# EAGLE board BMS-HVver2.5 (EAGLE 7.7.0), part 2 of 2
## Tracks (layer width: path | path; a pad name or v marks a point on that pad's centre or on a via) (continued)
N$17 (continued)
  Top 0.406: Q8.1 123.93,74.63 arc-45 124.11,74.56 124.92,73.75 126.03,73.75 arc45 R18.1
N$18
  Top 0.406: R56.P$2 108.48,73.81 arc45 108.66,73.88 R57.P$2 114.7,76.98 arc45 114.88,77.05 115.67,77.84 117.21,77.84 arc45 D5.A 118.89,77.9 arc-45 119.06,77.83 119.41,77.49 119.41,76.17 arc45 119.48,75.99 119.94,75.53 120.57,75.53 arc45 Q8.3
N$19
  Top 0.406: R19.2 116.98,75.54 arc45 117.16,75.62 D5.C
N$20
  Top 0.406: Q6.1 123.6,59.14 arc-45 123.78,59.06 124.21,58.64 124.21,57.86 arc45 124.28,57.68 124.56,57.4 125.94,57.4 arc-45 126.12,57.32 R21.1
N$21
  Top 0.406: R52.P$2 108.48,61.1 arc45 108.66,61.18 R53.P$2 116.01,64.28 arc-45 116.19,64.21 D6.A 117.13,63.26 118.16,63.26 118.34,63.09 118.34,60.6 118.85,60.09 Q6.3
N$22
  Top 0.406: R22.2 115.47,62.72 arc-45 115.65,62.64 D6.C
N$23
  Top 0.406: R56.P$1 114.84,73.81 arc45 R19.1 119.39,73.84 arc-45 119.57,73.77 120.12,73.22 120.12,69.95 arc45 120.19,69.77 120.47,69.49 122.5,69.49 arc-45 122.68,69.41 122.96,69.13 122.96,68.5 arc-45 Q7.2 125.72,68.41 arc45 125.9,68.48 R17.1
  Bottom 0.406: R57.P$1 108.42,76.98 arc-45 108.6,76.91 R56.P$1 arc45 111.76,73.95 111.76,75.18 111.93,75.34 arc-45 112.11,75.42 F30.2
N$24
  Top 0.406: Q7.1 125.72,66.5 arc-45 125.9,66.43 R24.1
N$25
  Top 0.406: R54.P$2 108.48,67.45 arc45 108.66,67.53 R55.P$2 113.89,70.63 arc-45 114.07,70.56 115.49,69.13 116.63,69.13 arc-45 116.81,69.06 117.09,68.78 D7.A 120.17,68 arc-45 120.35,67.92 Q7.3
N$26
  Top 0.406: R25.2 115.53,67.92 arc-45 115.71,67.85 116.03,67.53 116.03,66.04 arc45 116.1,65.86 116.21,65.75 116.84,65.75 arc45 117.03,65.83 D7.C
N$27  (via drill 0.5)
  Top 0.406: R54.P$1 111.7,66.81 arc45 111.77,66.63 112.29,66.11 114.72,66.11 arc45 114.89,66.18 R25.1 114.94,65.35 arc45 115.01,65.17 115.32,64.86 121.79,64.86 arc-45 121.97,64.79 122.78,63.98 122.78,61.26 | 122.78,61.26 arc-45 122.71,61.08 Q6.2 | R23.1 125.74,60.24 v124.56,60.24 123.54,61.26 122.78,61.26
  Bottom 0.406: R55.P$1 108.42,70.63 arc-45 108.6,70.56 R54.P$1 | F31.2 124.71,60.39 v124.56,60.24
N$28
  Top 0.406: R52.P$1 114.74,61.1 arc-45 114.92,61.03 R22.1 114.94,60.02 arc45 115.01,59.84 115.67,59.17 119.66,59.17 arc-45 119.84,59.1 120.47,58.46 120.47,58.21 arc45 120.55,58.03 121.01,57.57 122.32,57.57 arc-45 122.5,57.5 122.96,57.04 122.96,54.79 arc-45 Q5.2 125.72,54.69 arc45 125.9,54.76 R20.1
  Bottom 0.406: R53.P$1 108.42,64.28 arc-45 108.6,64.21 R52.P$1 arc-45 111.76,61.13 117.45,61.13 117.91,60.67 arc-45 117.98,60.49 117.98,50.28 117.61,49.91 arc-45 117.43,49.84 F32.2
N$29
  Top 0.406: Q5.1 125.99,52.79 arc-45 R27.1
N$30
  Top 0.406: R50.P$2 108.48,54.76 arc45 108.66,54.83 R51.P$2 112.19,57.93 arc45 112.37,58 112.83,58.46 118.41,58.46 arc-45 118.59,58.39 118.87,58.11 118.87,57.09 arc45 D9.A 120.21,57.02 arc-45 120.39,56.95 120.83,56.51 120.83,53.76 arc-45 Q5.3
N$31
  Top 0.406: R28.2 117.18,57.38 arc-45 117.36,57.31 117.81,56.86 117.81,56.26 arc45 117.88,56.08 118.16,55.8 118.59,55.8 arc-45 118.77,55.72 118.87,55.62 118.87,54.99 arc45 D9.C
N$32  (via drill 0.5)
  Top 0.406: R50.P$1 111.7,55.28 arc-45 111.77,55.45 112.29,55.97 114.79,55.97 arc-45 114.97,55.9 R28.1 116.92,55.68 arc-45 117.1,55.61 117.45,55.26 117.45,54.46 118.25,53.66 118.25,53.22 118.87,52.6 120.55,52.6 arc-45 120.72,52.52 121.18,52.06 121.18,50.39 arc45 121.26,50.21 121.54,49.93 122.89,49.93 arc-45 Q4.2 125.72,49.86 arc45 125.9,49.94 R26.1 | v123.85,45.31 121.72,45.31 v121.36,45.66
  Bottom 0.406: R51.P$1 108.42,57.93 arc-45 108.6,57.86 R50.P$1 arc45 111.76,54.73 113.18,54.73 113.64,54.27 arc-45 113.72,54.09 113.72,49.22 114.18,48.76 arc45 114.35,48.68 119.05,48.68 119.51,48.23 arc-45 119.58,48.05 119.58,46.2 120.12,45.66 v121.36,45.66 | F33.2 124.84,41.12 124.21,41.75 124.21,44.95 v123.85,45.31
N$33
  Top 0.406: Q4.1 125.86,47.96 arc45 126.04,48.04 R30.1
N$34
  Top 0.406: R48.P$2 108.48,48.41 arc45 108.66,48.48 R49.P$2 117.91,51.58 arc-45 118.09,51.51 D10.A 119.52,51.49 arc-45 119.7,51.41 120.12,51 120.12,49.85 arc45 120.19,49.67 Q4.3
N$35
  Top 0.406: R31.2 117.76,49.64 arc-45 117.94,49.56 D10.C
N$36
  Top 0.406: R48.P$1 113.36,48.41 arc-45 113.54,48.33 114.07,47.8 114.94,47.8 arc45 115.12,47.87 R31.1 arc45 115.14,47.81 115.14,47.26 115.42,46.98 arc45 115.6,46.91 116.38,46.91 116.74,46.55 119.23,46.55 120.29,45.48 120.29,43.71 120.83,43.17 122.71,43.17 Q2.2 124.37,43.26 arc-45 124.55,43.19 124.92,42.82 124.92,42.39 arc45 124.99,42.21 125.27,41.93 125.92,41.93 arc45 126.1,42 R29.1
  Bottom 0.406: R49.P$1 108.42,51.58 arc-45 108.6,51.51 R48.P$1 | F34.2 116.8,32.31 arc45 116.98,32.39 117.81,33.22 117.81,47.16 arc45 117.73,47.34 117.17,47.9 112.21,47.9 R48.P$1 | 111.88,48.23 R48.P$1
N$37
  Top 0.406: Q2.1 123.78,41.36 arc-45 123.96,41.28 124.92,40.33 125.98,40.33 arc-45 R33.1
N$38
  Top 0.406: R46.P$2 108.48,42.05 arc45 108.66,42.13 R47.P$2 117.46,45.23 arc45 117.64,45.3 D11.A 119.09,45.52 arc-45 119.27,45.44 119.58,45.13 119.58,42.92 arc45 119.66,42.74 119.94,42.46 120.44,42.46 arc-45 120.62,42.39 Q2.3
N$39
  Top 0.406: R34.2 117.5,43.67 arc-45 117.68,43.59 D11.C
N$40
  Top 0.406: R46.P$1 114.74,42.05 arc-45 114.92,41.98 R34.1 118.91,41.97 arc-45 119.09,41.89 119.58,41.39 119.58,40.79 arc45 119.66,40.61 119.94,40.33 122.32,40.33 arc-45 122.5,40.25 122.78,39.97 122.78,38.93 arc45 122.86,38.75 Q1.2 125.95,38.69 arc-45 R32.1
  Bottom 0.406: R47.P$1 108.42,45.23 arc-45 108.6,45.16 R46.P$1 114.07,42.05 114.35,41.77 arc-45 114.43,41.59 114.43,28.06 115.19,27.3 arc45 115.37,27.22 F35.2
N$41
  Top 0.406: R36.1 123.07,36.85 arc45 Q1.1
N$42
  Top 0.406: R44.P$2 108.48,35.7 arc45 108.66,35.78 R45.P$2 111.76,39.33 arc-45 111.83,39.51 112.12,39.79 118.01,39.79 arc-45 118.19,39.72 D12.A 120.26,39.55 arc-45 120.44,39.48 120.83,39.08 120.83,37.76 arc-45 Q1.3
N$43
  Top 0.406: R37.2 117.83,37.88 arc-45 118.01,37.8 D12.C
N$44
  Top 0.406: Q3.1 125.95,32.47 arc45 R39.1
N$45
  Top 0.406: R40.2 118.1,31.09 arc45 D13.C
N$46  (via drill 0.5)
  Top 0.178: R3.1 138.81,77.81 R2.1
  Top 0.406: Q12.2 124.47,103.97 arc-45 124.65,103.89 | 124.65,103.89 125.09,103.45 125.84,103.45 arc45 126.02,103.52 R4.1 | F25.2 125.73,105.4 | 125.73,105.4 125.73,104.97 124.65,103.89 | R3.1 136.6,79.39 v136.83,79.62 | v127.41,105.4 125.73,105.4
  Bottom 0.406: v136.83,79.62 136.83,103.62 135.59,104.87 127.94,104.87 v127.41,105.4
N$47
  Top 0.406: R42.P$2 108.48,29.35 arc45 108.66,29.43 R43.P$2 112.36,33.12 arc-45 112.53,33.2 D13.A 120.5,33.2 arc45 120.67,33.27 Q3.3
N$48
  Top 0.406: R42.P$1 114.84,29.35 arc45 R40.1 114.94,21.86 115.85,20.95 122.61,20.95 123.67,19.88 123.67,14.9 124.38,14.19 125.18,14.19 R38.1 125.27,14.18 125.27,13.12 125.65,12.74 U$1.1 125.47,10.93 R41.1
  Bottom 0.406: R43.P$1 108.42,32.53 arc-45 108.6,32.46 R42.P$1
N$49
  Top 0.406: R44.P$1 113.01,35.7 arc45 113.19,35.78 R37.1 113.64,36.12 arc-45 113.72,35.94 113.72,34.99 114.27,34.44 arc45 114.45,34.37 Q3.2 125.85,34.37 arc45 126.03,34.44 R35.1
  Bottom 0.406: R45.P$1 108.42,38.88 arc-45 108.6,38.81 R44.P$1 113.01,35.7 113.64,35.08 arc-45 113.72,34.9 113.72,23.62 114.42,22.91 arc45 114.6,22.84 F36.2
N$50
  Top 0.178: C2.1 140.78,75.86 R2.2 140.78,78.87 140.03,79.62 138.79,79.62 138.25,80.16 138.25,83 137.72,83.53 137.72,91.29 U$30.P$2
N$52
  Top 0.178: R67.5 R67.6 | R67.6 R67.7 R67.8 | Q13.3 140.36,53.99 140.74,54.37 141.37,54.37 R67.6
N$53
  Top 0.178: R66.1 R68.1 139.76,49.4 137.72,49.4 136.83,50.28 136.83,54.55 137.22,54.94 Q13.1
N$55
  Top 0.406: Q25.1 20.25,99.02 20.57,98.7 21.88,98.7 R154.1
N$56
  Top 0.406: R212.P$2 3.17,99.2 R211.P$2 12.74,102.38 D25.A 16.1,102.41 16.51,102 16.51,100.14 Q25.3
N$57
  Top 0.406: R156.2 D25.C
N$58
  Top 0.406: R212.P$1 8.13,99.2 8.64,98.7 9.87,98.7 R156.1 16.09,98.61 16.51,98.19 16.51,95.14 16.76,94.89 19.22,94.89 Q24.2 21.9,94.82 R153.1
  Bottom 0.406: R211.P$1 3.12,102.38 R212.P$1 7.05,99.97 21.59,99.97 22.23,100.6 F2.2
N$59
  Top 0.406: Q24.1 20.51,92.92 21.08,92.35 21.83,92.35 R155.1
N$60
  Top 0.406: R209.P$2 3.17,92.86 R210.P$2 10.54,96.03 11.18,96.66 12.79,96.66 D26.A 15.28,96.62 15.75,96.16 15.75,94.38 16.26,93.87 Q24.3
N$61
  Top 0.406: R157.2 D26.C
N$62  (via drill 0.5)
  Top 0.406: R209.P$1 10.12,92.86 R157.1 15.79,92.82 16.26,92.35 16.26,86.76 16.76,86.25 18.71,86.25 Q23.2 20.39,86.19 20.83,85.74 21.88,85.74 R152.1 | v21.62,96.87 18.06,96.87 v17.97,96.78
  Bottom 0.406: 3.05,97.94 2.54,97.43 2.54,96.09 R210.P$1 3.12,96.03 R209.P$1 8.1,92.86 8.55,93.3 8.55,95.98 9.35,96.78 v17.97,96.78 | F3.2 22.05,97.3 v21.62,96.87
N$63
  Top 0.406: Q23.1 20.25,84.28 20.83,83.71 20.83,83.46 21.08,83.2 21.88,83.2 R159.1
N$64
  Top 0.406: R207.P$2 3.17,86.5 R208.P$2 10.29,89.68 10.92,90.31 13.24,90.31 D27.A 15.08,90.22 15.49,89.81 15.49,85.74 16,85.23 Q23.3
N$65
  Top 0.406: R160.2 D27.C
N$66
  Top 0.406: R207.P$1 10.07,86.5 R160.1 14.31,86.42 14.73,86 14.73,84.65 15.49,83.89 15.49,80.92 15.75,80.66 18.59,80.66 Q22.2 21.82,80.6 R158.1
  Bottom 0.406: R208.P$1 3.12,89.68 R207.P$1 6.95,87.16 F4.2
N$67
  Top 0.406: Q22.1 20.25,78.7 20.83,78.12 21.83,78.12 R162.1
N$68
  Top 0.406: R205.P$2 3.17,80.16 R206.P$2 10.29,83.33 10.92,83.97 13.24,83.97 D28.A 14.57,83.87 14.73,83.71 14.73,79.9 14.99,79.65 Q22.3
N$69
  Top 0.406: R163.2 D28.C
N$70
  Top 0.406: R205.P$1 10.07,80.16 R163.1 13.55,80.07 13.97,79.65 13.97,78.89 14.48,78.38 16.26,78.38 16.51,78.12 16.51,76.6 16.76,76.34 18.59,76.34 Q21.2 21.94,76.28 R161.1
  Bottom 0.406: R206.P$1 3.12,83.33 R205.P$1 6.65,80.51 F5.2
N$71
  Top 0.406: Q21.1 20.25,74.38 20.83,73.81 R165.1
N$72
  Top 0.406: R203.P$2 3.17,73.81 R204.P$2 9.78,76.98 10.41,77.61 13.24,77.61 D29.A 14.32,77.52 14.73,77.11 14.73,75.58 14.99,75.33 Q21.3
N$73
  Top 0.406: R166.2 D29.C
N$74
  Top 0.406: Q19.1 20.25,61.68 21.08,60.85 21.88,60.85 R168.1
N$75
  Top 0.406: R199.P$2 3.81,61.1 R200.P$2 9.78,64.28 10.41,64.92 13.24,64.92 D30.A 14.32,64.82 14.73,64.41 14.73,62.88 14.99,62.63 Q19.3
N$76
  Top 0.406: R169.2 D30.C
N$77
  Top 0.406: R203.P$1 10.07,73.81 R166.1 16.85,73.72 17.27,73.3 17.27,71.27 17.78,70.76 18.59,70.76 Q20.2 18.71,70.63 21.21,70.63 21.84,70 21.84,68.26 R164.1
  Bottom 0.406: R204.P$1 3.12,76.98 R203.P$1 6.67,73.42 F6.2
N$78
  Top 0.406: Q20.1 20.51,68.79 20.83,68.47 20.83,65.93 21.34,65.42 21.88,65.42 R171.1
N$79
  Top 0.406: R201.P$2 3.17,67.45 R202.P$2 10.29,70.63 10.92,71.27 13.24,71.27 D31.A 14.32,71.17 14.73,70.76 14.73,70 14.99,69.74 Q20.3
N$80
  Top 0.406: R172.2 D31.C
N$81
  Top 0.406: R201.P$1 10.07,67.45 R172.1 17.11,67.37 17.53,66.95 17.53,64.15 18.03,63.65 18.71,63.65 Q19.2 20.39,63.58 20.83,63.14 21.88,63.14 R170.1
  Bottom 0.406: R202.P$1 3.12,70.63 R201.P$1 6.67,67.07 F7.2
N$82
  Top 0.406: R199.P$1 10.07,61.1 R169.1 15.33,61.02 16,60.34 16,58.56 16.26,58.31 18.84,58.31 Q18.2 21.82,58.24 R167.1
  Bottom 0.406: R200.P$1 3.75,64.28 R199.P$1 8.13,61.1 8.64,60.6 8.64,60.09 8.89,59.84 17.08,59.84 17.62,59.3 17.62,56.95 18,56.57 F8.2
N$83
  Top 0.406: Q18.1 21.82,56.34 R174.1
N$84
  Top 0.406: R197.P$2 3.81,54.76 R198.P$2 9.78,57.93 10.16,58.31 13.17,58.31 D32.A 14.57,58.47 14.99,58.06 14.99,57.55 15.24,57.3 Q18.3
N$85
  Top 0.406: R175.2 D32.C
N$86
  Top 0.406: R197.P$1 10.07,54.76 R175.1 16.85,54.67 17.53,53.99 17.53,50.44 18.03,49.93 18.71,49.93 Q17.2 21.82,49.86 R173.1
  Bottom 0.406: R198.P$1 3.75,57.93 R197.P$1 7.01,54.67 R175.1 10.59,54.23 10.59,50.28 11.57,49.31 F9.2
N$87
  Top 0.406: Q17.1 21.77,47.96 R177.1
N$88
  Top 0.406: R195.P$2 3.81,48.41 R196.P$2 10.03,51.58 10.67,52.22 13.24,52.22 D33.A 14.57,52.12 15.24,51.45 15.24,49.42 15.75,48.91 Q17.3
N$89
  Top 0.406: R178.2 D33.C
N$90
  Top 0.406: R195.P$1 10.07,48.41 R178.1 14.82,48.32 15.24,47.9 15.24,46.88 15.49,46.63 17.27,46.63 17.78,46.12 17.78,43.83 18.03,43.58 18.72,43.58 Q15.2 20.13,43.77 20.57,43.33 R176.1
  Bottom 0.406: R196.P$1 3.75,51.58 R195.P$1 7.01,48.32 R178.1 10.67,47.81 10.67,38.75 11.68,37.74 11.7,37.75 16.9,37.75 17.26,37.39 17.26,34.99 17.65,34.6 F10.2
N$91
  Top 0.406: Q15.1 20.25,41.87 20.57,41.55 20.57,41.04 20.83,40.78 R180.1
N$92
  Top 0.406: R193.P$2 3.81,42.05 R194.P$2 9.78,45.23 10.41,45.86 13.24,45.86 D34.A 14.83,45.77 15.24,45.36 15.24,43.33 15.75,42.82 Q15.3
N$93
  Top 0.406: R181.2 D34.C
N$94  (1 unrouted)
  Top 0.406: R193.P$1 10.07,42.05 R181.1 | Q14.2 20.13,38.94 20.57,38.5 22.14,38.5 R179.1
  Bottom 0.406: R194.P$1 3.75,45.23 R193.P$1 8.64,42.05 9.4,41.29 9.4,37.23 9.65,36.98 10.67,36.98 10.92,36.72 10.92,32.91 11.43,32.4 F11.2
N$95
  Top 0.406: Q14.1 21.27,37.04 21.84,36.47 21.84,33.92 R183.1
N$96
  Top 0.406: R191.P$2 3.81,35.7 R192.P$2 10.54,38.88 10.92,39.26 13.17,39.26 D35.A 14.83,39.42 15.24,39.01 15.24,38.25 15.49,37.99 Q14.3
N$97
  Top 0.406: R184.2 D35.C
N$98
  Top 0.406: Q16.1 20.25,31.71 20.57,31.39 20.57,30.62 20.83,30.37 R186.1
N$99
  Top 0.406: R187.2 D36.C
N$100
  Top 0.178: R150.1 35.22,88.79 R149.1
  Top 0.406: Q25.2 20.25,100.92 20.57,101.24 21.88,101.24 R151.1 22.1,101.2 22.1,102.51 22.61,103.02 31.57,103.02 | F1.2 34.93,103.4 34.54,103.02 31.57,103.02 | R149.1 32.32,88.83 32.11,89.05 32.11,102.48 31.57,103.02
N$101
  Top 0.406: R189.P$2 3.81,29.35 R190.P$2 10.8,32.53 11.43,33.16 13.24,33.16 D36.A 15.08,33.07 15.49,32.66 Q16.3
N$102
  Top 0.406: Q38.1 74.6,101.43 R79.1
N$103
  Top 0.406: R136.P$2 59.06,99.2 R137.P$2 67.28,102.38 D8.A 70.37,102.41 Q38.3
N$104
  Top 0.406: R81.2 D8.C
N$105
  Top 0.406: R189.P$1 10.07,29.35 R187.1 10.33,29.1 22.1,29.1 22.86,28.34 22.86,12.59 24.35,11.11 R188.1 30.75,11.12 U$14.1
  Bottom 0.406: R190.P$1 3.75,32.53 R189.P$1 | U$14.1 34.87,13.95 R185.1
N$106  (via drill 0.5)
  Top 0.406: R191.P$1 10.07,35.7 R184.1 10.25,35.7 14.99,35.7 15.49,35.2 15.49,34.18 16.07,33.61 Q16.2 20.39,33.61 20.83,33.16 20.83,32.4 21.34,31.89 21.83,31.89 R182.1 | v17.79,26.81 v21.35,26.81
  Bottom 0.406: R192.P$1 3.75,38.88 R191.P$1 9.14,35.7 9.65,35.2 9.65,27.58 10.41,26.81 v17.79,26.81 | v21.35,26.81 22.61,26.81 23.11,26.31 24.08,26.31 24.46,25.93 25.3,25.93 F12.2
N$107
  Top 0.178: R149.2 37.44,90.53 C64.1 38.62,90.53 39.04,90.11 39.04,87.62 39.22,87.44 43.13,87.44 43.31,87.62 43.31,90.61 U$28.P$2
N$108
  Top 0.406: R136.P$1 63.2,99.2 63.75,98.65 65.37,98.65 R81.1 72.07,98.61 72.54,98.14 72.54,95.37 | F14.2 58.65,106.19 58.32,105.86 58.32,102.54 R137.P$1 | 72.54,95.37 Q37.2 | 72.54,95.37 74.61,95.37 R78.1
  Bottom 0.406: R137.P$1 59,102.38 R136.P$1
N$110
  Top 0.406: Q37.1 74.52,93.3 R80.1
N$111
  Top 0.406: R134.P$2 59.06,92.86 R135.P$2 65.56,96.03 66.04,96.51 67.12,96.51 D14.A 69.89,96.32 70.1,96.11 70.1,94.42 Q37.3
N$112
  Top 0.406: D14.C R82.2
N$113
  Top 0.406: R134.P$1 63.6,92.86 64.01,92.45 65.34,92.45 R82.1 68.82,92.51 69.7,91.64 74.57,91.64 74.98,91.23 74.98,89.67 Q36.2 77.19,89.61 R77.1
  Bottom 0.406: R134.P$1 59,96.03 R135.P$1 58.73,96.28 58.73,96.92 59.11,97.3 F15.2
N$114
  Top 0.178: Q26.3 48.69,55.75 49,55.44 49,54.02 48.64,53.66 47.04,53.66 46.51,53.13 46.51,48.33 46.15,47.97 45.47,47.97 R214.5 R214.6 R214.7 R214.8
N$115
  Top 0.406: Q36.1 75.65,87.71 76.2,87.16 77.18,87.16 R84.1
N$116
  Top 0.406: R132.P$2 59.06,86.5 R133.P$2 66.12,89.68 66.45,90.01 67.78,90.01 D15.A 68.84,89.97 69.7,90.82 72.54,90.82 72.95,90.42 Q36.3
N$117
  Top 0.406: R85.2 D15.C
N$118
  Top 0.406: R132.P$1 63.45,86.5 64.01,85.95 65.19,85.95 R85.1 65.59,86.35 72.95,86.35 73.26,86.04 Q35.2 77.07,84.79 R83.1
  Bottom 0.406: R132.P$1 59,89.68 R133.P$1 58.32,89.84 58.32,90.82 58.73,91.23 63.6,91.23 64.3,90.53 F16.2
N$119
  Top 0.178: Q26.1 47.11,54.8 46.86,54.55 44.49,54.55 R215.1 R213.1
N$121
  Top 0.406: Q35.1 74.79,82.89 75.39,82.29 77.03,82.29 R87.1
N$122
  Top 0.406: R130.P$2 59.06,80.16 R131.P$2 65.05,83.33 65.63,83.91 67.78,83.91 D16.A 71.13,83.87 Q35.3
N$123
  Top 0.406: R88.2 D16.C
N$124
  Top 0.406: R130.P$1 65.32,80.16 R88.1 72.33,80.07 73.36,79.04 73.36,78.02 | 73.36,78.02 Q34.2 | 73.36,78.02 75.19,78.02 75.39,78.22 77.05,78.22 R86.1
  Bottom 0.406: R131.P$1 59,83.33 R130.P$1 63.08,79.24 F17.2
N$125  (4 unrouted)
N$126
  Top 0.406: Q34.1 74.33,76.03 75.39,74.97 77.15,74.97 R90.1
N$127
  Top 0.406: R128.P$2 59.06,73.81 R129.P$2 64.39,76.98 64.82,77.41 67.71,77.41 D17.A 69.18,77.52 69.7,77 71.14,77 Q34.3
N$128
  Top 0.406: R91.2 D17.C
N$129  (4 unrouted)
N$130
  Top 0.406: Q32.1 77.21,62.57 77.42,62.78 77.42,64.12 R93.1
N$131
  Top 0.406: R124.P$2 59.06,61.1 R125.P$2 64.69,64.28 65.23,64.81 67.3,64.81 | 67.3,64.81 D18.A | 67.3,64.81 68.07,64.81 68.48,64.41 68.48,64 68.89,63.59 71.34,63.59 Q32.3
N$132
  Top 0.406: R94.2 D18.C
N$133  (via drill 0.5)
  Top 0.178: v38.61,70.12 38.73,70.12 39.12,70.5 40.49,70.5 U3.35
  Bottom 0.178: C90.1 38.48,70 v38.61,70.12
N$134
  Top 0.406: R128.P$1 65.32,73.81 R91.1 65.44,73.75 72.95,73.75 73.52,73.19 73.52,72.37 | Q33.2 73.52,72.37 | 73.52,72.37 74.17,71.72 77.08,71.72 R89.1
  Bottom 0.406: R129.P$1 59,76.98 R128.P$1 62.38,73.59 62.38,72.94 62.57,72.75 F18.2
N$135  (via drill 0.3)
  Top 0.178: U1.35 142.29,65.18 142.16,65.31 142.16,65.84 v141.9,66.02
  Bottom 0.178: v141.9,66.02 C30.1
N$136
  Top 0.406: Q33.1 74.77,66.63 74.98,66.84 74.98,68.88 75.39,69.28 77.18,69.28 R96.1
N$137
  Top 0.406: R126.P$2 59.06,67.45 R127.P$2 64.95,70.63 65.63,71.32 67.17,71.32 D19.A 68.22,71.17 68.48,70.91 68.48,68.06 68.89,67.66 71.34,67.66 Q33.3
N$138
  Top 0.406: R97.2 D19.C
N$139  (via drill 0.5)
  Top 0.406: R126.P$1 65.32,67.45 R97.1 67.96,67.37 68.48,66.84 68.48,65.63 68.89,65.22 72.77,65.22 Q32.2 75.86,64.47 76.2,64.81 76.2,66.44 76.61,66.84 77.23,66.84 R95.1 | v79.22,62.46 78.87,62.46 77.27,60.86 v71.67,60.86
  Bottom 0.406: R127.P$1 59,70.63 R126.P$1 62.26,67.37 67.67,67.37 68.48,66.55 68.48,61.75 69.37,60.86 v71.67,60.86 | F19.2 78.03,61.54 v79.22,62.46
N$142
  Top 0.406: R124.P$1 65.32,61.1 R94.1 65.43,61.04 67.67,61.04 68.2,60.51 68.2,59.8 68.61,59.39 Q31.2 77.16,59.39 R92.1
  Bottom 0.406: R125.P$1 59,64.28 R124.P$1 62.26,61.02 66.85,61.02 67.31,60.56 F20.2
N$144
  Top 0.406: Q31.1 77.06,57.49 R99.1
N$145
  Top 0.406: R122.P$2 59.06,54.76 R123.P$2 64.44,57.93 65.23,58.72 67.19,58.72 D20.A 71.26,58.6 Q31.3
N$146
  Top 0.406: R100.2 67.18,56.37 D20.C
N$147  (via drill 0.5)
  Top 0.406: R122.P$1 65.32,54.76 R100.1 68.49,54.67 69.29,55.47 75.39,55.47 75.79,55.06 75.79,54.25 | Q30.2 74.94,51.77 75.39,52.22 75.39,53.84 75.79,54.25 | 75.79,54.25 77.13,54.25 R98.1 | v73.27,43.53 v76.82,43.53
  Bottom 0.406: R123.P$1 59,57.93 R122.P$1 64.41,54.76 64.82,54.35 64.82,51.81 65.63,51 73.36,51 73.99,50.36 73.99,44.25 v73.27,43.53 | F21.2 77,41.93 76.82,42.11 v76.82,43.53
N$149
  Top 0.406: Q30.1 76.7,49.87 77.01,50.18 77.01,51.34 R102.1
N$150
  Top 0.406: R120.P$2 59.06,48.41 R121.P$2 64.59,51.58 65.23,52.22 67.28,52.22 D21.A 68.85,52.25 69.29,51.81 69.29,51 69.7,50.59 71.31,50.59 Q30.3
N$151
  Top 0.406: R103.2 D21.C
N$152
  Top 0.406: R120.P$1 65.37,48.41 R103.1 73.06,48.44 73.76,47.74 73.76,47.06 Q28.2 74.99,46.94 75.39,47.34 75.39,48.15 75.79,48.56 77.1,48.56 R101.1
  Bottom 0.406: R121.P$1 59,51.58 R120.P$1 62.21,48.44 66.04,48.44 66.93,47.55 F22.2
N$154
  Top 0.406: Q28.1 75.12,45.04 76.61,46.52 77.18,46.52 R105.1
N$155
  Top 0.406: R118.P$2 59.06,42.05 R119.P$2 64.75,45.23 65.23,45.71 67.5,45.71 D22.A 67.91,45.99 Q28.3
N$156
  Top 0.406: R106.2 D22.C
N$159
  Top 0.406: R118.P$1 65.19,42.05 R106.1 68.26,41.84 68.48,42.05 73.58,42.05 Q27.2 76.39,41.86 77.01,41.24 77.01,39.71 R104.1
  Bottom 0.406: R119.P$1 59,45.23 R118.P$1 64.41,42.05 65.23,41.24 65.23,35.15 66.45,33.93 76.2,33.93 76.87,33.25 F23.2
N$161
  Top 0.406: Q27.1 75.04,39.96 75.39,39.62 75.39,37.18 75.79,36.77 77.05,36.77 R108.1
N$162
  Top 0.406: R116.P$2 59.06,35.7 R117.P$2 67.4,38.88 D23.A 67.56,40.33 68.07,40.84 71.59,40.84 Q27.3
N$163
  Top 0.406: R109.2 67.06,37.44 D23.C
N$165
  Top 0.406: Q29.1 74.43,30.82 75.39,29.86 77.13,29.86 R111.1
N$166
  Top 0.406: R112.2 D24.C
N$170
  Top 0.178: R74.1 92.08,78.52 R75.1
  Top 0.406: Q38.2 73.42,103.33 73.71,103.62 74.56,103.62 | 74.56,103.62 R76.1 | 74.56,103.62 74.56,106.67 | 74.56,106.67 74.56,107.47 74.98,107.89 76.04,107.89 F13.2 | R74.1 91.1,81.21 90.83,81.48 90.83,105.86 90.02,106.67 74.56,106.67
N$175
  Top 0.406: R114.P$2 59.06,29.35 R115.P$2 62.77,33.07 D24.A 70.55,33.07 70.92,32.71 70.92,32.01 Q29.3
N$176
  Top 0.406: R114.P$1 65.06,29.35 R112.1 65.23,29.19 65.23,12.39 66.38,11.23 R113.1 72.26,11.36 R110.1 77.08,11.12 U$40.1
  Bottom 0.406: R115.P$1 59,32.53 R114.P$1
N$177
  Top 0.406: R116.P$1 65.37,35.7 R109.1 65.23,35.57 65.23,34.74 65.63,34.33 72.54,34.33 73.26,33.61 Q29.2 77.07,32.72 R107.1
  Bottom 0.406: R117.P$1 59,38.88 R116.P$1 66.29,31.58 F24.2
N$178  (via drill 0.5, 0.6)
  Top 0.178: R74.2 92.08,84.86 C21.1 93.92,85.02 v94.16,84.78 | v99.49,83.53 99.49,85.83 U$29.P$2
  Bottom 0.178: v94.16,84.78 94.16,83.71 94.51,83.36 99.31,83.36 v99.49,83.53
N$192
  Top 0.178: R139.8 R139.7 R139.6 R139.5 98.48,42.27 arc45 98.66,42.34 98.96,42.64 98.96,48.24 arc45 Q39.3
N$193
  Top 0.178: R140.1 100.87,52.52 arc45 100.69,52.6 100.03,52.6 99.5,52.07 arc-45 99.32,52 R138.1 98.38,51.96 arc-45 98.2,51.88 97.18,51.88 96.86,51.57 arc45 96.79,51.39 Q39.1
N$262  (via drill 0.5)
  Top 0.406: U$15.1 25.27,22.8 v25.17,22.9
  Bottom 0.406: v25.17,22.9 25.17,24.1 F12.1
N$264
  Bottom 0.406: U$16.1 27.13,27.37 26.42,28.09 26.42,32.4 25.91,32.91 20.92,32.91 F11.1
N$286
  Bottom 0.406: U$17.1 24.29,36.14 24.12,35.96 23.11,35.96 21.76,34.6 F10.1
N$287
  Bottom 0.406: F9.1 35.13,49.31 36.11,48.33 36.11,44.89 U$18.1
N$288
  Bottom 0.406: U$19.1 22.2,53.64 21.84,53.99 21.84,56.06 21.34,56.57 F8.1
N$289
  Bottom 0.406: U$20.1 26.92,62.38 26.42,62.88 26.42,65.17 25.91,65.68 22.61,65.68 22.1,66.19 22.1,66.69 21.84,66.95 20.54,66.95 F7.1
N$290
  Bottom 0.406: F6.1 21.97,73.42 22.61,72.79 22.61,71.77 23.11,71.27 25.15,71.27 U$21.1
N$291
  Bottom 0.406: U$22.1 22.61,79.88 21.97,80.51 F5.1
N$292
  Bottom 0.406: F4.1 24.8,87.16 25.26,87.62 25.26,88.6 U$23.1
N$293
  Bottom 0.406: F3.1 36.04,97.3 U$24.1
N$294
  Bottom 0.406: F2.1 22.23,105.94 22.61,106.32 25.07,106.32 U$25.1
N$295
  Top 0.406: F1.1 34.93,113.58 U$26.1
N$296
  Bottom 0.406: U$41.1 68.2,18.61 67.67,18.08 66.56,18.08 F24.1
N$297
  Bottom 0.406: U$42.1 81.51,26.64 81.08,26.2 78.8,26.2 F23.1
N$298
  Bottom 0.406: U$43.1 67.07,36.11 F22.1
N$299
  Bottom 0.406: U$44.1 81.51,42.2 F21.1
N$300
  Bottom 0.406: U$45.1 69.09,53.64 68.48,53.03 67.55,53.03 F20.1
N$301
  Bottom 0.406: F19.1 81.13,59.84 81.53,60.24 81.53,62.35 U$46.1
N$302
  Bottom 0.406: U$47.1 66.1,71.11 F18.1
N$303
  Bottom 0.406: F17.1 80.87,79.24 U$48.1
N$304
  Bottom 0.406: U$49.1 68.14,88.64 F16.1
N$305
  Bottom 0.406: U$50.1 79.03,97.38 F15.1
N$306
  Top 0.406: F14.1 70.59,106.19 U$51.1
N$307
  Top 0.406: F13.1 79.93,107.97 80.26,108.3 U$52.1
N$308
  Bottom 0.406: U$2.1 116.08,20.93 arc45 116,21.11 F36.1
N$309
  Bottom 0.406: U$3.1 124.63,27.37 arc45 124.45,27.3 F35.1
N$310
  Bottom 0.406: U$4.1 F34.1
N$311
  Bottom 0.178: 126.92,43.19 arc-45 126.85,43.01
  Bottom 0.406: U$5.1 126.92,43.19 | 126.85,43.01 F33.1
N$312
  Bottom 0.406: U$6.1 116.08,51.9 arc-45 116,51.72 F32.1
N$313
  Bottom 0.406: U$7.1 126.23,63.07 124.92,63.07 F31.1
N$314
  Bottom 0.406: U$8.1 116.08,73.36 arc45 116,73.54 F30.1
N$315
  Bottom 0.406: U$9.1 126.92,77.88 arc45 F29.1
N$316
  Bottom 0.406: U$10.1 116.05,86.65 arc45 F28.1
N$317
  Bottom 0.406: F27.1 126.56,94.86 126.87,95.18 126.87,97.33 U$11.1
N$318
  Bottom 0.406: F26.1 116.21,105.88 arc45 116.13,106.06 U$12.1
N$319
  Top 0.406: U$13.1 125.68,111.41 F25.1
S1
  Top 0.178: R111.2 arc-45 79.02,30.02 85.98,30.02 86.26,30.3 arc45 86.34,30.48 86.34,60.06 86.62,60.34 arc-45 86.8,60.42 95.2,60.42 95.38,60.6 95.38,60.98 94.95,60.98 U2.25
S2
  Top 0.178: U2.23 85.89,61.57 85.62,61.31 85.62,37.59 arc-45 85.55,37.41 85.09,36.95 79.02,36.95 arc-45 R108.2
S3
  Top 0.178: U2.21 85.46,62.57 84.91,62.02 84.91,47.08 84.73,46.91 80.47,46.91 80.11,46.55 79.06,46.55 R105.2
S4
  Top 0.178: U2.19 84.51,63.57 84.2,63.26 84.2,52.42 83.49,51.71 79.08,51.71 R102.2
S5
  Top 0.178: R99.2 83.03,57.3 83.49,57.75 83.49,64.15 83.84,64.51 87.96,64.51 U2.17
S6
  Top 0.178: U2.15 83.31,65.57 82.78,65.04 82.78,64.51 82.42,64.15 79.08,64.15 R93.2
S7
  Top 0.178: R96.2 82.37,69.36 82.6,69.13 82.6,67.35 83.31,66.64 87.95,66.64 U2.13
S8
  Top 0.178: R90.2 82.53,75.08 83.31,74.29 83.31,67.89 83.67,67.53 87.98,67.53 U2.11
S9
  Top 0.178: R87.2 83.72,82.06 84.02,81.75 84.02,69.31 84.73,68.6 87.99,68.6 U2.9
S10
  Top 0.178: R84.2 84.15,87.14 84.73,86.56 84.73,69.84 85.09,69.49 87.94,69.49 U2.7
S11
  Top 0.178: R80.2 85.12,93.11 85.45,92.78 85.45,70.73 85.62,70.55 88,70.55 U2.5
S12
  Top 0.178: U2.3 86.56,71.57 86.16,71.98 86.16,101.13 85.8,101.49 R79.2
S13
  Top 0.178: R7.2 133.48,101.11 133.81,100.78 133.81,89.4 134.34,88.87 134.87,88.87 135.05,88.69 135.05,71.09 135.41,70.73 137.25,70.73 U1.3
S14
  Top 0.178: R8.2 132.77,92.22 133.1,91.89 133.1,89.05 134.34,87.8 134.34,70.38 135.05,69.67 137.28,69.67 U1.5
S15
  Top 0.178: R12.2 133.22,87.14 133.63,86.73 133.63,69.58 134.43,68.78 137.2,68.78 U1.7
S16
  Top 0.178: R15.2 132.26,82.06 132.92,81.4 132.92,68.6 133.81,67.71 137.27,67.71 U1.9
S17
  Top 0.178: R18.2 131.8,73.81 132.21,73.4 132.21,67.53 133.1,66.64 137.26,66.64 U1.11
S18
  Top 0.178: R21.2 129.62,57.3 129.9,57.57 129.9,59.53 130.07,59.71 130.07,64.51 130.25,64.69 137.29,64.69 U1.15
S19
  Top 0.178: U1.13 130.68,65.68 130.25,66.11 127.93,66.11 R24.2
S20
  Top 0.178: U1.17 131.02,63.68 130.78,63.44 130.78,53.13 130.43,52.77 127.9,52.77 R27.2
S21
  Top 0.178: U1.19 131.98,62.68 131.5,62.2 131.5,48.68 130.96,48.15 R30.2
S22
  Top 0.178: U1.21 132.58,61.68 132.21,61.31 132.21,40.68 131.85,40.33 127.95,40.33 R33.2
S23
  Top 0.178: U1.23 133.36,60.68 132.92,60.24 132.92,37.66 132.21,36.95 127.95,36.95 R36.2
S24
  Top 0.178: U1.25 139.08,60.18 138.61,59.71 133.99,59.71 133.63,59.35 133.63,33.22 132.92,32.5 127.93,32.5 R39.2
S25
  Top 0.178: U3.3 31.09,76.02 30.86,76.24 30.86,98.29 30.42,98.65 23.79,98.65 R154.2
S26
  Top 0.178: U3.5 30.31,75.02 29.97,75.35 29.97,91.89 29.62,92.25 23.79,92.25 R155.2
S27
  Top 0.178: U3.7 29.36,74.02 29.08,74.29 29.08,82.91 28.64,83.36 23.73,83.36 R159.2
S28
  Top 0.178: U3.9 28.53,73.02 28.25,73.3 28.25,77.79 27.84,78.2 23.81,78.2 R162.2
S29
  Top 0.178: U3.11 27.57,72.02 27.39,72.19 27.39,73.46 27.14,73.81 R165.2
S30
  Top 0.178: U3.15 29.26,70.02 28.91,69.67 28.91,61.22 28.46,60.77 23.76,60.77 R168.2
S31
  Top 0.178: U3.13 28.21,71.02 28.02,70.82 28.02,66.2 27.39,65.58 23.73,65.58 R171.2
S32
  Top 0.178: U3.17 30.21,69.02 29.79,68.6 29.79,56.51 29.35,56.15 R174.2
S33
  Top 0.178: U3.19 30.99,68.02 30.68,67.71 30.68,48.15 30.33,47.8 23.79,47.8 R177.2
S34
  Top 0.178: U3.21 31.59,67.02 31.39,66.82 31.39,41.22 31.04,40.86 23.79,40.86 R180.2
S35
  Top 0.178: U3.23 32.37,66.02 32.11,65.75 32.11,34.28 31.75,33.93 23.89,33.93 R183.2
S36
  Top 0.178: U3.25 38.71,65.52 38.24,65.04 33.17,65.04 32.82,64.69 32.82,30.73 32.46,30.37 R186.2
SWTEN
  Top 0.178: U2.36 98.75,66.57 arc-45 98.93,66.5 99.14,66.29 99.14,66.04 arc45 99.21,65.86 99.49,65.58 100.06,65.58 arc45 100.25,65.65 SJ10.1
SWTEN1
  Top 0.178: U1.36 148.1,65.68 149.1,64.69 149.1,48.59 148.74,48.24 145.1,48.24 144.25,47.39 SJ5.1
SWTEN2
  Top 0.178: U3.36 43.2,71.02 43.48,70.73 43.48,69.93 43.66,69.75 44.37,69.75 44.55,69.93 44.55,70.61 SJ15.1
V+
  Top 0.178: C20.1 93.72,78.36 R75.2 93.62,78.24 93.62,77.49 93.27,77.13 87.4,77.13 86.87,76.6 86.87,72.86 87.16,72.57 U2.1
V+1
  Top 0.178: U1.1 135.88,71.68 135.76,71.8 135.76,73.75 135.94,73.93 136.44,73.93 C1.1 136.54,76.04 R3.2
V+2
  Top 0.178: U3.1 31.87,77.02 31.75,77.13 31.75,82.29 32.11,82.64 33.59,82.64 C63.1 33.64,85.84 R150.2
VREF1
  Top 0.178: U2.35 97.49,66.07 97.71,65.84 97.71,64.69 98.07,64.33 98.67,64.33 C58.1
VREF2  (via drill 0.5)
  Top 0.178: Q39.2 97.45,47.45 arc45 97.63,47.53 97.89,47.8 97.89,50.18 arc-45 97.97,50.36 98.25,50.64 100.77,50.64 arc45 100.95,50.72 R140.2 101.06,50.64 v102.87,50.64 | v93.22,64.53 93.22,65.3 93.47,65.55 94.84,65.55 U2.34 96.37,65.57 arc-45 96.55,65.5 97,65.04 97,63.73 arc45 97.08,63.55 97.36,63.26 104.34,63.26 104.47,63.39 v104.47,64.51
  Bottom 0.178: v104.47,64.51 104.47,51.17 103.94,50.64 v102.87,50.64 | C59.1 93.27,64.58 v93.22,64.53
VREF4  (via drill 0.3)
  Top 0.178: Q13.2 137.94,51.84 138.43,51.35 139.89,51.35 R68.2 140.02,51.35 140.92,51.35 141.1,51.17 141.1,50.64 141.28,50.46 143.76,50.46 143.94,50.28 147.85,50.28 148.21,50.64 148.21,57.75 147.32,58.64 147.32,64.33 146.97,64.68 U1.34 142.16,64.68 v141.99,64.51
  Bottom 0.178: v141.99,64.51 141.17,64.51 C31.1
VREF6
  Top 0.178: U3.34 41.89,70.02 43.84,68.06 43.84,65.04 43.66,64.86 43.66,61.35 C91.1 43.66,61.17 43.66,58.29 44.02,57.93 44.02,56.72 R215.2 45.15,56.57 45.44,56.86 47.72,56.86 Q26.2
VREG  (via drill 0.5)
  Top 0.178: SJ9.1 SJ8.1 SJ7.1 SJ6.1 99.97,77.44 100.56,78.02 101.45,78.02 101.8,78.38 101.8,85.82 U$29.P$3 | 99.85,67.07 U2.37 93.47,67.07 93.22,66.82 v93.22,66.36 | 99.85,67.07 99.9,67.07 SJ10.2 | SJ9.1 99.97,67.2 99.85,67.07 | U2.40 99.82,68.57 SJ9.1
  Bottom 0.178: C61.1 C60.1 92.91,67 93.22,66.69 v93.22,66.36
VREG1  (via drill 0.3)
  Top 0.178: SJ4.1 SJ3.1 SJ2.1 SJ1.1 140.83,43.67 140.83,45.84 | U1.37 145.28,66.18 145.9,66.18 | 145.9,66.18 148.14,66.18 149.45,64.86 149.45,47.71 149.01,47.26 145.45,47.26 144.03,45.84 140.83,45.84 | 140.82,36.06 SJ4.1 | 145.9,66.18 145.9,67.18 145.45,67.62 144.03,67.62 143.79,67.68 U1.40 142.19,67.68 141.99,67.89 141.99,79.44 141.63,79.8 140.56,79.8 140.03,80.33 140.03,91.28 U$30.P$3 | SJ5.2 141.23,46.95 140.83,46.55 140.83,45.84 | SJ4.1 140.84,45.83 140.83,45.84
  Top 0.406: v145.19,66.82 145.19,66.27 145.28,66.18
  Bottom 0.406: C32.1 144.68,67.33 v145.19,66.82
VREG2  (via drill 0.5)
  Top 0.178: U$28.P$3 45.65,88.89 45.26,88.51 44.55,88.51 44.2,88.16 44.2,84.91 SJ11.1 SJ12.1 SJ13.1 SJ14.1 44.25,75.66 44.55,75.35 48.46,75.35 49,74.82 49,70.38 48.82,70.2 45.97,70.2 45.97,72.33 45.62,72.69 44.73,72.69 44.55,72.51 | 43.4,72.42 43.31,72.33 43.31,71.8 42.77,71.44 41.71,71.44 41.46,71.52 U3.37 39.24,71.52 38.99,71.77 v38.61,71.77 | 43.4,72.42 43.66,72.69 44.37,72.69 44.55,72.51 | 44.55,72.51 44.55,71.72 SJ15.2 | U3.40 40.53,73.04 42.77,73.04 43.4,72.42
  Bottom 0.178: C92.1 C93.1 v38.61,71.77